# EasyEDA Pro project Cerberus_Sub_Controller_v01.eprj, board Cerberus_Sub_Controller_v01 (continued)
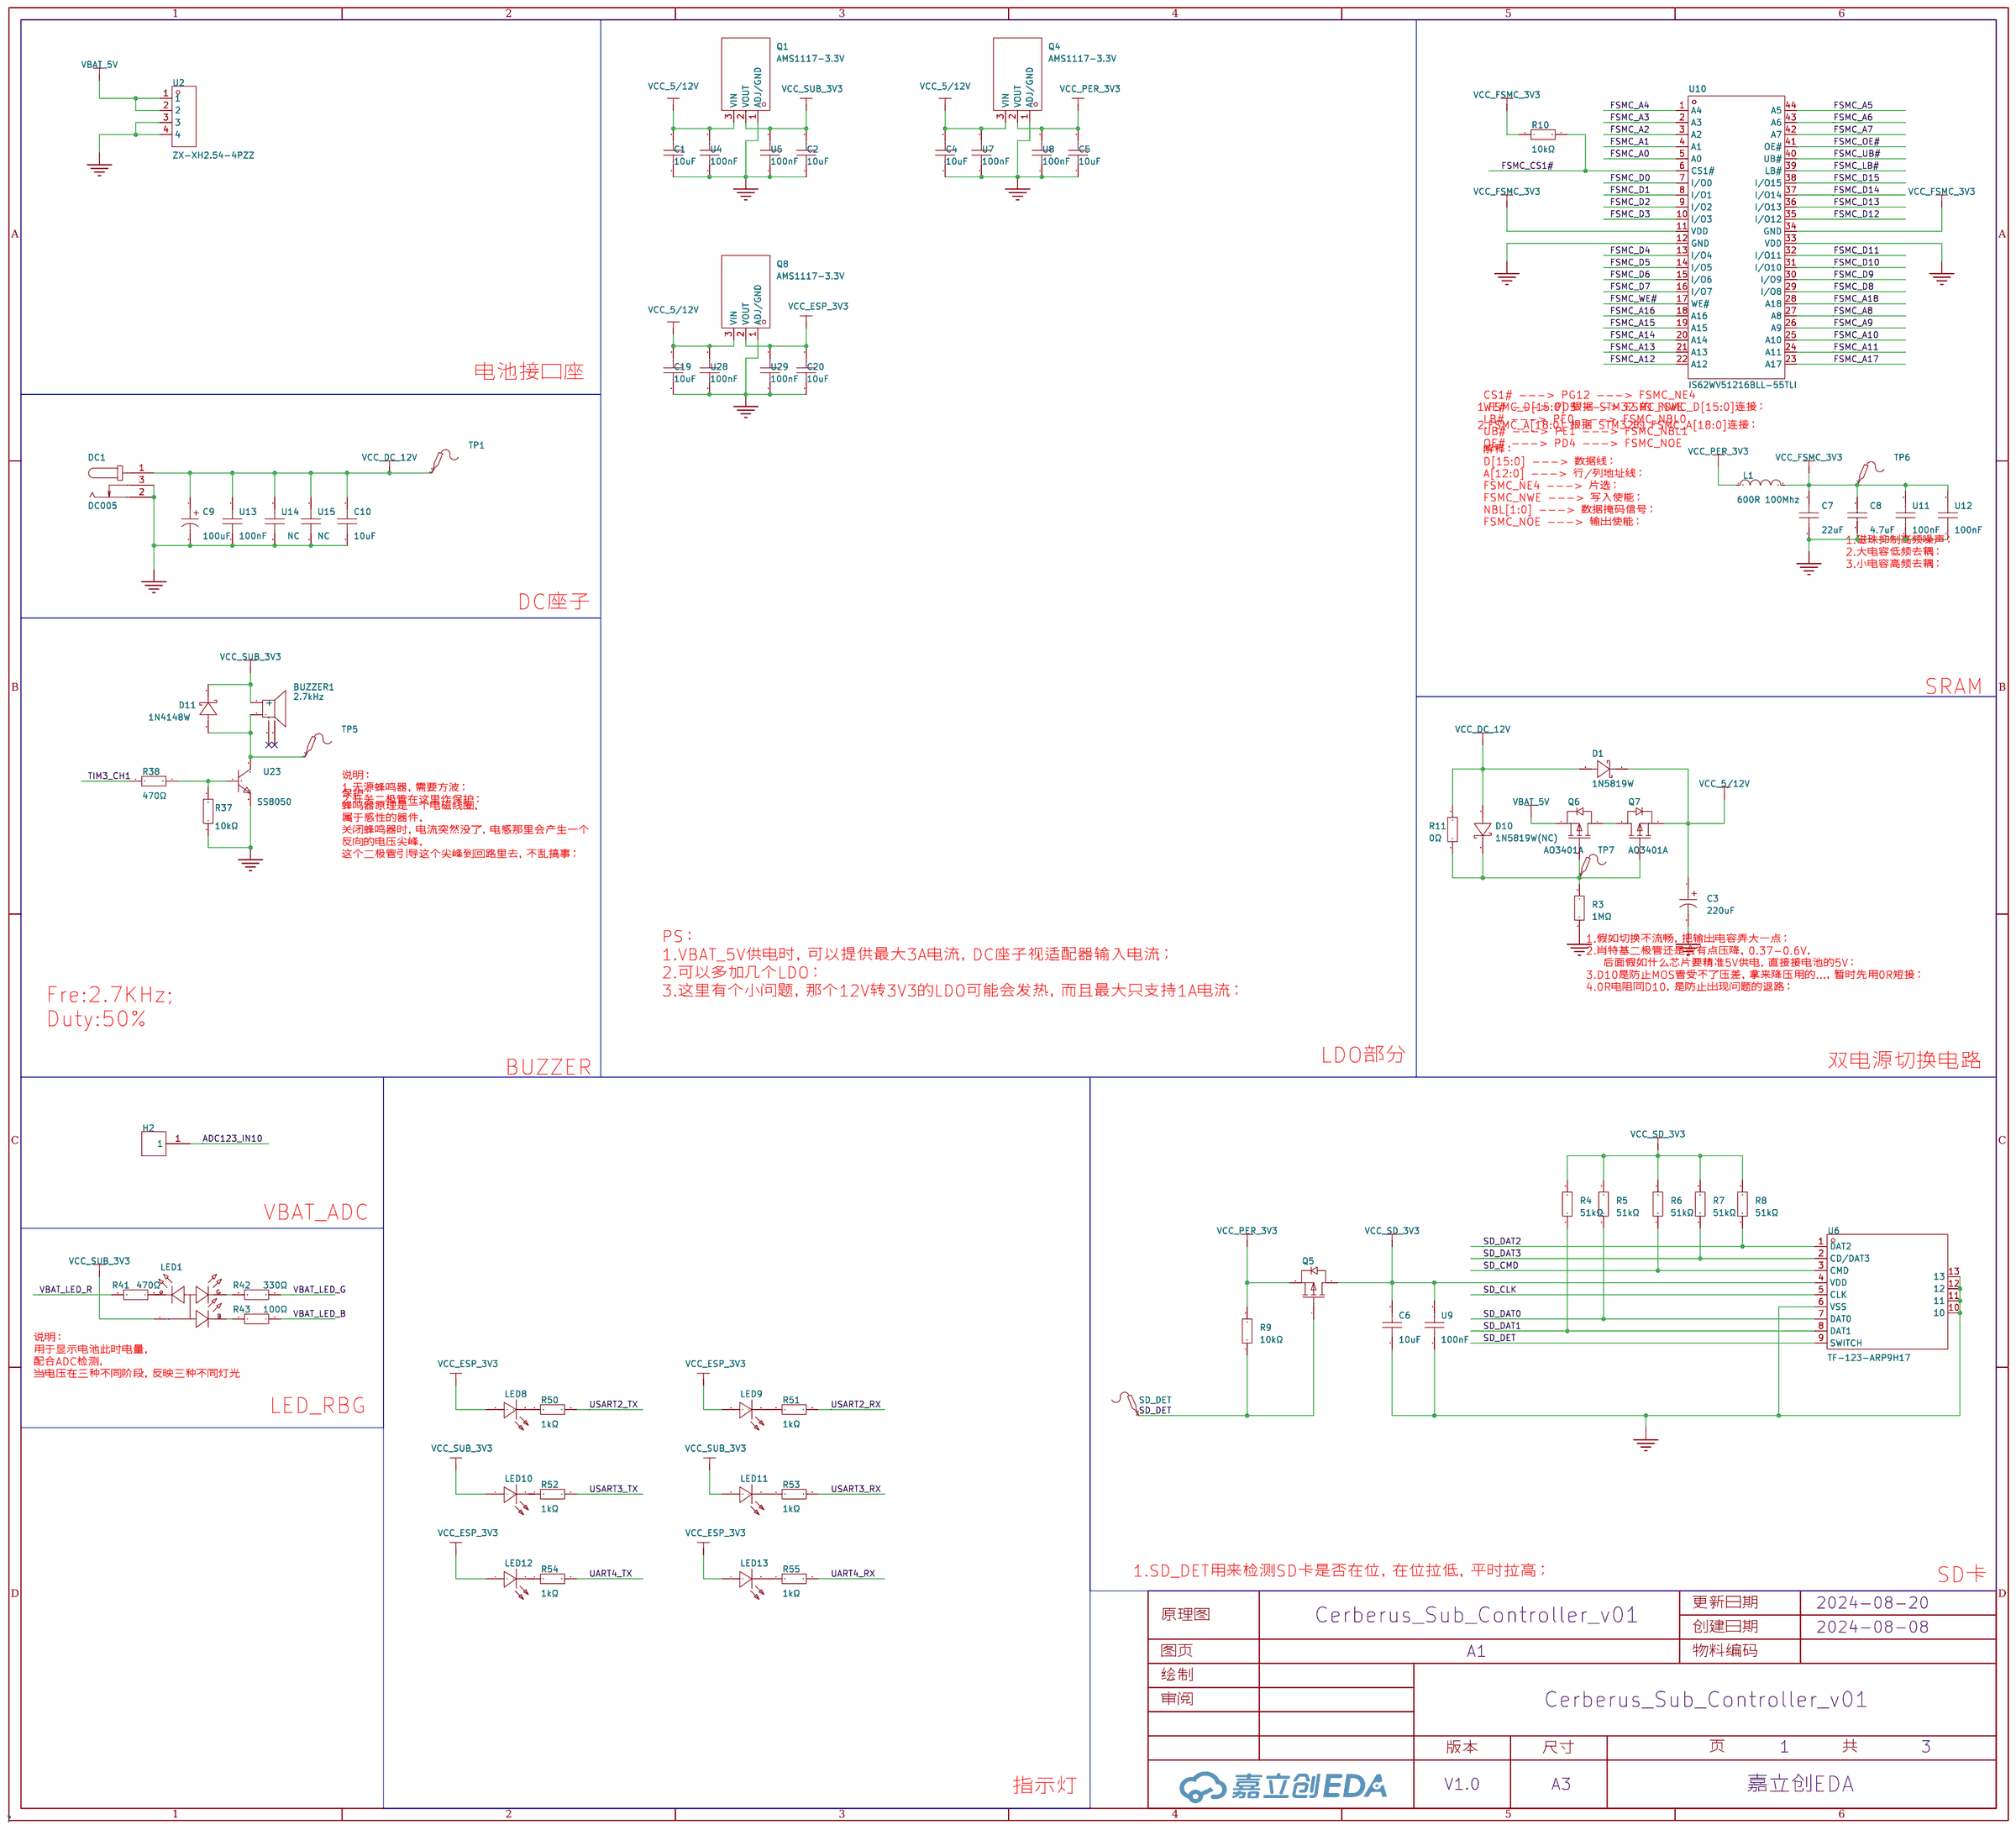
[diagram p0: A1]
## Routing (per net, layer and track width the routed paths; a pad name or vN(x,y) marks a point on that pad's centre or on a via; arc(x,y) is an arc through that point) (continued)
PC13: length 33.6
  Top Layer w0.203: U24.16 50.93,69.59 52.32,69.59 59.06,62.86 59.06,58.54 v1(60.71,56.89)
  SN_IMT w0.381: v1(60.58,50.92) 60.71,51.04 v1(60.71,56.89)
PD2: length 42.9
  Top Layer w0.203: U6.3 38.99,66.41 v1(38.1,65.52) ; v1(42.67,60.44) 42.67,54.98 48.26,49.39 v1(53.97,49.39)
  POWER w0.381: v1(53.97,49.39) 55.04,48.33 55.04,42.61 58.67,38.98 v1(59.69,38.98)
  Bottom Layer w0.203: 38.1,65.02 v1(38.1,65.52) ; 38.1,65.02 38.1,65.01 v1(42.67,60.44) ; 38.1,65.02 R6.1
PD3: length 58.6
  Top Layer w0.203: v1(62.36,65.39) 60.2,67.55 60.2,70.47 U24.20 ; CN1.39 66.34,38.94 v1(66.42,38.85)
  SN_NRM w0.381: v1(62.36,65.39) 64.64,63.11 70.61,63.11 74.42,59.3 74.42,41.77 71.25,38.6 66.68,38.6 v1(66.42,38.85)
PD6: length 79
  Top Layer w0.203: CN1.36 55.66,40.53 55.63,40.5
  SN_IMT w0.381: v1(33.4,73.27) 36.96,69.71 36.96,64.25 40.89,60.31 40.89,54.6 40.13,53.84 40.13,49.65 42.42,47.36 46.99,47.36 47.5,46.85 47.5,45.96 46.99,45.46 42.54,45.46 42.04,44.95 42.04,40.25 42.42,39.87 46.86,39.87 47.5,40.5 v1(55.5,40.5)
  SN_NRM w0.381: v1(33.4,73.27) 24.38,73.27 20.95,76.7
PD7: length 51.4
  Top Layer w0.203: v1(70.99,68.19) 70.23,68.19 67.18,71.24 61.98,71.24 U24.21 ; CN1.35 66.39,40.53 v1(66.42,40.5)
  SN_IMT w0.381: v1(70.99,68.19) 72.9,66.28 72.9,47.87 v1(71.12,46.09)
  Bottom Layer w0.203: v1(71.12,46.09) 66.42,41.39 v1(66.42,40.5)
PDR_ON: length 7.5
  Top Layer w0.203: CN1.18 59.81,47.74 R39.1 R40.2
PE2: length 45.5
  Top Layer w0.203: 59.06,76.7 63.5,72.25 68.07,72.25 73.66,66.67 v1(73.66,65.14) ; v1(72.01,56.12) v1(72.01,49.14)
  Bottom Layer w0.203: v1(64.39,47.74) 65.79,47.74 66.24,47.28 70.16,47.28 v1(72.01,49.14) ; v1(72.01,56.12) 73.66,57.78 v1(73.66,65.14)
PE3: length 47
  SN_IMT w0.381: 38.74,76.7 47.5,67.94 52.83,67.94 56.39,64.38 56.39,56.63 58.04,54.98 58.93,54.98 v1(59.82,55.87)
  SN_NRM w0.381: v1(59.06,48.63) 61.47,48.63 62.36,49.52 62.36,54.98 61.47,55.87 v1(59.82,55.87)
PE4: length 44.9
  Top Layer w0.203: v1(76.58,63.11) 76.58,65.01 68.33,73.27 65.02,73.27 U24.23 ; v1(70.99,54.22) v1(70.99,49.14)
  Bottom Layer w0.203: v1(64.39,48.5) 70.36,48.5 v1(70.99,49.14) ; v1(76.58,63.11) 76.58,59.81 v1(70.99,54.22)
PE5: length 41
  Top Layer w0.203: CN1.14 60.9,49.33 61.72,50.16 v1(61.72,51.17)
  SN_IMT w0.381: v1(58.55,55.87) 58.55,64.38 53.85,69.08 48.9,69.08 41.28,76.7
  Bottom Layer w0.203: v1(58.55,55.87) 59.56,54.85 60.96,54.85 61.72,54.09 v1(61.72,51.17)
PE6: length 40.5
  Top Layer w0.203: U24.24 66.8,74.03 68.58,74.03 77.09,65.52 v1(77.09,64)
  POWER w0.381: v1(67.06,51.04) 66.67,51.04 66.17,50.55 66.17,49.9 65.53,49.27 v1(64.9,49.27)
  Bottom Layer w0.203: v1(67.06,51.04) 68.71,51.04 77.09,59.43 v1(77.09,64)
PF6: length 141.3
  Top Layer w0.203: v1(16.26,21.96) 12.45,18.15 4.06,18.15 3.17,17.26 3.17,3.29 5.08,1.39 59.94,1.39 U25.8 ; 37.38,54.14 37.38,54.56 36.45,55.49 33.66,55.49 32.89,56.25 v1(32.13,56.25)
  SN_IMT w0.381: v1(32.13,56.25) 26.29,56.25 24,53.97 20.95,53.97 18.8,51.81 18.8,33.77 v1(16.64,31.61)
  Bottom Layer w0.203: v1(16.26,21.96) 16.26,31.23 v1(16.64,31.61)
PF7: length 61.1
  SN_IMT w0.381: 38.74,3.04 33.4,8.37 v1(33.4,25.01)
  POWER w0.381: v1(30.23,43.3) 31.24,44.31 34.16,44.31 35.05,45.2 35.05,53.33 34.29,54.09 v1(33.15,54.09)
  SN_NRM w0.381: v1(30.23,43.3) v1(30.23,37.96)
  Bottom Layer w0.203: v1(30.23,37.96) 32.51,35.68 33.4,35.68 34.42,34.66 34.42,32.25 33.4,31.23 v1(33.4,25.01)
PF8: length 145.2
  Top Layer w0.203: v1(17.65,21.96) 12.95,17.26 v1(4.57,17.26)
  SN_IMT w0.381: v1(37.72,53.33) 38.61,53.33 38.99,53.71 38.99,55.74 36.32,58.41 26.92,58.41 v1(23.62,55.11)
  POWER w0.381: v1(17.65,31.61) 17.65,52.19 20.57,55.11 v1(23.62,55.11)
  Bottom Layer w0.203: v1(4.57,17.26) 3.68,16.37 3.68,2.91 5.33,1.26 57.28,1.26 59.06,3.04 ; v1(17.65,21.96) v1(17.65,31.61)
PF9: length 57
  POWER w0.381: v1(33.02,53.33) 34.04,53.33 34.42,52.95 34.42,49.9 33.78,49.27 32.51,49.27 29.56,46.31 29.56,29.11 v1(32.51,26.15)
  SN_NRM w0.381: U25.18 32.51,6.72 v1(32.51,26.15)
PF11: length 44.8
  Top Layer w0.203: 15.88,3.04 18.92,6.09 29.72,6.09 31.24,7.61 v1(31.24,24.63)
  Bottom Layer w0.203: v1(31.24,24.63) 30.35,25.52 30.35,31.87 30.99,32.5 v1(33.02,32.5)
PG6: length 116.9
  Top Layer w0.203: v1(25.27,13.96) 27.18,12.06 v1(30.73,12.06)
  SN_IMT w0.381: v1(20.19,24.37) 13.08,31.49 13.08,61.97 8,67.05 8,74.41 5.72,76.7 ; v1(25.27,13.96) 23.63,15.6 21.47,15.6 v1(21.08,15.99)
  SN_NRM w0.381: v1(37.47,16.12) 42.93,21.58 42.93,23.1 45.85,26.03 55.25,26.03 57.91,28.69 57.91,30.6 58.29,30.98 v1(59.44,30.98)
  Bottom Layer w0.203: v1(21.08,15.99) 20.19,16.88 v1(20.19,24.37) ; v1(30.73,12.06) 34.8,16.12 v1(37.47,16.12)
PG7: length 65
  Top Layer w0.203: v1(59.69,61.2) 59.69,63.36 U24.17 ; v1(65.79,30.85) 65.7,30.94 CN1.59
  SN_IMT w0.381: v1(65.79,30.85) 66.93,30.85 70.99,34.92 v1(70.99,42.79)
  SN_NRM w0.381: v1(70.99,42.79) 70.36,43.42 70.36,57.39 68.07,59.68 60.32,59.68 59.69,60.31 v1(59.69,61.2)
PG8: length 116.8
  Top Layer w0.203: v1(14.99,33.64) 14.99,30.85 v1(21.34,24.5) ; v1(30.73,13.32) 27.81,13.32 v1(25.15,15.99) ; v1(41.4,25.26) 40,25.26 37.72,22.98 37.72,17.9 v1(36.7,16.88)
  SN_IMT w0.381: v1(21.84,16.37) 24.77,16.37 v1(25.15,15.99) ; U24.2 10.54,74.41 10.54,68.44 14.35,64.63 14.35,55.23 13.97,54.85 13.97,34.66 v1(14.99,33.64)
  SN_NRM w0.381: v1(59.44,31.74) 57.78,31.74 57.02,30.98 57.02,29.2 54.48,26.66 44.45,26.66 43.05,25.26 v1(41.4,25.26)
  Bottom Layer w0.203: v1(30.73,13.32) 34.29,16.88 v1(36.7,16.88) ; v1(21.34,24.5) 21.34,16.88 v1(21.84,16.37)
PG9: length 64.8
  Top Layer w0.203: v1(54.48,53.97) 54.48,52.82 55.5,51.81 55.5,50.79 57.53,48.76 v1(57.53,48.63) ; v1(58.17,42.15) 58.99,41.33 CN1.34
  POWER w0.381: v1(56.9,46.09) 56.51,45.7 56.51,43.31 57.66,42.15 v1(58.17,42.15)
  SN_NRM w0.381: 23.5,76.7 26.16,74.03 48.01,74.03 54.48,67.55 v1(54.48,53.97)
  Bottom Layer w0.203: v1(57.53,48.63) 57.53,46.73 v1(56.9,46.09)
PG10: length 9.3
  Top Layer w0.203: R42.2 67.63,41.33 CN1.33
PG11: length 63.9
  SN_NRM w0.381: v1(61.59,47.87) 62.99,49.27 62.99,57.27 62.61,57.65 60.96,57.65 58.93,59.68 58.93,64.63 48.64,74.92 27.81,74.92 26.03,76.7
  Bottom Layer w0.203: v1(61.59,47.87) 61.59,43.3 v1(60.58,42.28)
PG13: length 58.4
  Top Layer w0.203: v1(61.47,42.41) 60.94,42.94 CN1.30
  SN_IMT w0.381: U24.10 34.16,71.11 34.16,61.84 v1(38.86,57.14)
  SN_NRM w0.381: v1(38.86,57.14) 40,57.14 43.94,53.2 56.01,53.2 v1(57.15,52.06) 58.17,51.04 58.17,48.25 59.44,46.98 60.96,46.98 61.47,46.47 v1(61.47,42.41)
PG14: length 9.1
  Top Layer w0.203: R43.2 67.93,42.94 CN1.29
PG15: length 50.4
  Top Layer w0.203: v1(57.4,43.68) 59.76,43.68 CN1.28
  SN_IMT w0.381: v1(51.44,48) 46.99,48 41.4,53.58 41.4,60.82 37.47,64.76 37.47,70.35 31.12,76.7
  SN_NRM w0.381: v1(51.44,48) 51.44,47.11 52.45,46.09 54.99,46.09 v1(57.4,43.68)
SD_DET: length 14.9
  Top Layer w0.203: U6.9 42.73,64.96 43.43,64.25 48.94,64.25 Q5.1 50.86,64.7 R9.1 51.24,64.71 SD_DET.1
SWCLK: length 65.1
  Top Layer w0.203: U24.19 51.82,76.7 58.55,69.97 58.55,67.68 v1(60.83,65.39) ; CN1.47 66.35,35.73 v1(66.42,35.8) ; v1(73.66,48.63) v1(75.31,46.98)
  SN_NRM w0.381: v1(66.42,35.8) 74.04,35.8 75.31,37.07 v1(75.31,46.98) ; v1(73.66,48.63) 73.66,58.92 70.36,62.22 64.01,62.22 v1(60.83,65.39)
SWDIO: length 82.3
  Top Layer w0.203: v1(51.56,48.89) 50.29,47.61 50.29,45.96 v1(51.82,44.44)
  SN_IMT w0.254: v1(51.44,38.09) 52.96,36.57 54.86,36.57 55.63,35.8 v1(59.18,35.8)
  POWER w0.254: v1(51.82,44.44) 51.82,40.5 51.44,40.12 v1(51.44,38.09)
  SN_NRM w0.381: v1(40.26,71.62) 20.95,71.62 15.88,76.7
  Bottom Layer w0.203: v1(40.26,71.62) 50.04,71.62 53.85,67.81 53.85,52.95 52.07,51.17 52.07,49.39 v1(51.56,48.89)
VREF+: length 57.2
  Top Layer w0.203: v1(29.21,8.25) 24.51,12.94 v1(24.51,21.83) ; CN2.51 32.83,50.79 30.35,50.79 29.34,49.77 27.56,49.77 v1(27.05,49.27)
  Bottom Layer w0.203: v1(29.21,8.25) 31.12,6.34 31.12,3.04 ; v1(27.05,49.27) 23.88,46.09 23.88,22.47 v1(24.51,21.83)
$1N508:
  vias: v1(89.03,46.73) v1(89.03,46.09) v1(89.03,44.31) v1(89.03,42.53) v1(89.03,41.9) v1(90.04,44.31) v1(91.06,44.31)
$1N7566:
  vias: v1(83.76,36.94) v1(84.58,46.8) v1(84.65,45.62) v1(86.73,45.52) v1(86.73,41.2) v1(86.85,37.81)
$1N11787: length 12
  Top Layer w0.203: U23.3 76.6,22.94 BUZ_SN.1
  Top Layer w0.381: 76.58,24.14 77.66,23.06 BUZZER1.2 80.79,22.99 ; 76.58,24.14 D11.1 ; 76.58,24.14 76.58,22.99 U23.3
$1N11843: length 3.5
  Top Layer w0.203: U23.1 74.5,23.87 R38.2 R37.2
$1N12167: length 2.7
  Top Layer w0.203: R41.2 73.34,41.08 73.34,43.66
$1N12224: length 7.3
  Bottom Layer w0.203: v1(73.28,37.07) 72.64,37.71 72.64,42.78 v1(71.73,43.69)
$1N12304: length 6
  Bottom Layer w0.203: v1(71.7,44.46) 73.03,43.13 73.03,39.39 v1(73.31,39.11)
$1N13565: length 2.4
  Top Layer w0.203: TX2.2 20.41,17.9 R50.1
$1N13573: length 2.4
  Top Layer w0.203: RX2.2 20.45,14.38 R51.1
$1N13763: length 2.2
  Top Layer w0.203: TX3.2 61.73,7.61 R52.1
$1N13771: length 2.2
  Top Layer w0.203: R53.1 61.81,10.07 RX3.2
$1N13961: length 2.4
  Top Layer w0.203: R54.1 20.54,7.36 TX4.2
$1N13969: length 2.4
  Top Layer w0.203: R55.1 20.5,10.87 RX4.2
$2N431: length 2.8
  Top Layer w0.203: USB1.4 v1(90.93,68.08)
$2N434: length 2.8
  Top Layer w0.203: USB1.10 90.83,71.08 v1(90.93,70.98)
$2N1990: length 5.2
  Top Layer w0.203: R12.2 61.59,15.18 61.59,17.26 62.11,17.77 U16.9
$2N2067: length 2.2
  Top Layer w0.203: U16.10 62.61,17.17 C11.2
$2N2156: length 21.1
  Top Layer w0.203: v1(63.63,18.28) 63.61,18.3 U16.12
  SN_NRM w0.381: v1(63.63,18.28) 59.44,14.09 55.25,14.09 53.59,15.74 53.59,20.94 52.07,22.47 v1(51.44,22.47)
$2N2359: length 3.1
  Top Layer w0.203: C14.1 64.66,24.75 63.63,24.75 63.11,24.23 U16.20
$2N2438: length 2.9
  Top Layer w0.203: U16.24 v1(61.11,25.14)
  Bottom Layer w0.203: v1(61.11,25.14) 61.11,25.7 R14.1
$2N2441: length 1.5
  Top Layer w0.203: v1(61.89,24.37) 61.61,24.09 U16.23
$2N3213: length 1.3
  Top Layer w0.203: 51.09,18.02 50.84,17.77 U17.5
$2N5650: length 17.9
  Top Layer w0.203: R33.2 64.51,62.47 79.76,62.47 80.14,62.86 U1.6
$2N5692: length 22.1
  Top Layer w0.203: R34.2 62.19,62 79.95,62 81.41,63.46 81.41,64.49
$2N6121: length 17.6
  Top Layer w0.203: OPENMV4.3 9.29,68.3 19.18,58.41 21.73,58.41 R36.2
$2N6127: length 15.3
  Top Layer w0.203: R35.2 21.73,60.06 18.54,60.06 11.79,66.81 OPENMV4.2
$2N7761: length 3.8
  Bottom Layer w0.203: U30.3 5.49,54.7 R57.2
$2N9014: length 4.9
  Top Layer w0.203: ESP_IO0.4 11.3,26.15 13.59,26.15 13.88,26.44 v1(13.88,27.17)
$2N9237: length 9.3
  Top Layer w0.203: ESP_RST.4 12.32,58.59 12.32,64.51
  Bottom Layer w0.203: v1(12.32,64.53) R69.2
$2N9578: length 7.2
  Bottom Layer w0.203: R60.2 1.65,23.74 H8.1 H8.3
$2N9587: length 9.2
  Bottom Layer w0.203: H9.3 H9.1 8.77,22.85 R61.2

## Copper pours and planes (outline as drawn; the poured copper is in the pictures)
GND on Top Layer: -0.25,80.76 98.04,80.76 98.04,-0.9 -0.25,-0.9
GND on Bottom Layer: -1.4,82.86 98.68,82.86 98.68,-1.53 -1.4,-1.53
GND on SN_IMT: -1.91,82.03 97.79,82.03 97.79,-1.53 -1.91,-1.53
GND on GND: 0.26,79.74 94.74,79.74 94.74,0.26 0.26,0.26
GND on POWER: -1.4,83.05 98.68,83.05 98.68,-1.53 -1.4,-1.53
GND on SN_NRM: -1.65,83.05 98.3,83.05 98.3,-1.15 -1.65,-1.15
VBAT_5V on Bottom Layer: 82.55,46.09 84.33,44.31 86.49,44.31 87.25,43.55 87.25,42.66 86.49,41.9 84.33,41.9 82.8,40.38 81.03,40.38 80.01,41.39 80.01,45.09 81.02,46.09
VCC_5/12V on Bottom Layer: 76.71,56.63 77.6,57.52 84.07,57.52 84.71,56.89 84.71,54.52 84.07,53.89 77.68,53.89 76.71,54.85
VCC_5/12V on Bottom Layer: 86.11,46.98 87.38,46.98 88.52,48.12 88.52,50.03 88.01,50.54 85.98,50.54 85.47,50.03 85.47,47.61
VCC_5/12V on Bottom Layer: 81.66,37.33 82.3,37.96 82.3,39.16 81.72,39.74 78.87,39.74 78.49,39.36 78.49,37.71 78.87,37.33
VCC_5/12V on POWER: 86.11,46.85 87.47,46.85 88.58,47.97 88.58,53.03 84.07,57.54 80.01,57.54 79.25,56.78 79.25,55.49 79.63,55.11 81.91,55.11 85.47,51.55 85.47,47.61 85.98,47.11 85.98,46.98
VCC_5/12V on POWER: 76.58,54.98 76.58,56.89 71.63,61.84 52,61.84 51.32,61.16 51.32,60.58 51.05,60.31 50.04,60.31 49.78,60.57 49.78,61.2 49.15,61.84 27.9,61.84 26.93,60.88 26.93,60.32 26.8,60.19 25.4,60.19 25.27,60.31 25.27,60.95 23.11,63.11 23.11,63.87 23.5,64.25 74.47,64.25 75.06,63.65 75.06,62.27 80.48,56.85 80.48,55.96 79.5,54.98
VCC_5/12V on POWER: 78.74,37.33 81.66,37.33 81.66,40.5 80.01,42.15 80.01,53.97 81.15,55.11 83.51,55.11 83.51,56.63 81.31,56.63 80.48,57.45 80.48,57.61 77.55,57.61 76.58,56.63 76.58,39.49
VCC_DC_12V on Bottom Layer: 79.79,35.28 80.58,36.06 86.5,36.06 87.72,34.84 87.72,33.99 86.61,32.88 80.65,32.88 79.88,33.52 79.79,33.73
VCC_DC_12V on POWER: 82.59,8.92 83.44,9.77 83.44,22.29 85.95,24.81 85.95,32.48 87.63,34.15 87.63,34.92 86.79,35.76 83.23,35.76 83.19,35.8 80.81,35.8 79.63,34.63 79.63,33.77 80.52,32.88 82.17,32.88 82.55,32.5 82.55,27.04 79.25,23.74 79.25,10.28 80.61,8.92
VCC_ESP_3V3 on POWER: 18.8,65.52 22.61,65.52 23.11,65.01 23.11,64.12 20.91,62.43 18.8,61.2 18.16,64 18.16,64.89
VCC_ESP_3V3 on POWER: 19.05,61.46 20.57,61.46 20.95,61.84 21.21,61.84 21.21,62.98 21.34,63.11 20.7,63.11
VCC_ESP_3V3 on POWER: 14.73,51.81 15.24,52.31 16.13,52.31 16.26,52.19 16.26,49.77 16.13,49.65 14.73,49.65
VCC_PER_3V3 on Bottom Layer: 43.96,64.76 43.96,59.55 44.47,59.05 46.86,59.05 47.37,59.55 47.37,64.72 47.41,64.76
VCC_PER_3V3 on POWER: 47.11,58.91 47.08,58.94 44.24,58.94 43.69,59.5 43.69,60.82 44.2,61.33 48.26,61.33 50.16,59.43 49.65,58.91
VCC_PER_3V3 on POWER: 46.48,59.43 46.73,29.83 40.26,23.36 40.26,16.75 40.89,16.12 43.6,16.12 44.32,16.85 44.32,22.15 50.93,28.76 50.93,58.66 49.91,59.68 47.88,59.68
VCC_SD_3V3 on Bottom Layer: 34.29,67.94 34.54,68.19 36.19,68.19 36.39,67.99 36.39,66.49 36.19,66.29 34.54,66.29 34.29,66.54
VCC_SD_3V3 on POWER: 36.45,68.95 36.83,68.57 36.83,67.64 36.61,67.43 34.42,67.43 34.29,67.55 34.29,68.57 34.67,68.95
VCC_SUB_3V3 on Bottom Layer: 67.38,64.95 67.38,67.37 67.82,67.81 70.49,67.81 70.87,67.43 70.87,64.76 70.49,64.38 67.93,64.38 67.36,64.95
VCC_SUB_3V3 on Bottom Layer: 67.44,64.87 67.44,60.44 67.69,60.19 70.49,60.19 70.74,60.44 70.74,65.56 68.12,65.56
VCC_SUB_3V3 on POWER: 67.44,60.84 67.45,60.84 67.69,61.08 70.49,61.08 70.74,60.82 70.74,59.81 70.49,59.55 67.69,59.55 67.44,59.81
VCC_SUB_3V3 on POWER: 79.76,31.49 81.15,31.49 81.66,30.98 81.66,29.45 81.15,28.95 79.73,28.95 78.74,29.94 78.74,30.47
VCC_SUB_3V3 on POWER: 67.56,28.18 67.56,16.88 66.8,16.12 66.8,14.72 67.44,14.09 69.6,14.09 70.36,14.85 70.36,28.69 68.07,28.69
VCC_SUB_3V3 on POWER: 67.56,56.5 67.56,28.18 68.07,27.68 69.85,27.68 70.49,28.31 70.49,55.76 69.72,56.5 69.72,57.52 68.58,57.52
VCC_SUB_3V3 on POWER: 67.44,60.44 67.44,56.38 65.91,54.85 59.18,54.85 58.8,54.47 58.8,54.09 59.06,53.84 62.99,53.84 63.25,53.58 63.25,53.2 63.37,53.08 68.71,53.08 70.61,54.98 70.61,60.31 70.48,60.44
VCC_SUB_3V3 on POWER: 67.44,67.3 67.82,67.68 70.49,67.68 70.87,67.3 70.87,65.9 70.61,65.65 67.82,65.65 67.44,66.03
VCC_SUB_3V3 on POWER: 67.82,67.68 67.82,77.32 68.46,77.97 80.08,77.97 80.65,77.41 80.65,76.06 80.01,75.43 70.99,75.43 70.36,74.79 70.36,67.68 70.49,67.55 67.94,67.55
$1N508 on Bottom Layer: 88.26,46.73 89.03,47.49 91.1,47.49 91.69,46.9 91.69,41.77 91.06,41.14 88.77,41.14 88.26,41.65
$1N508 on POWER: 88.9,41.01 88.26,41.65 88.26,46.79 88.96,47.49 91.19,47.49 91.82,46.85 91.82,41.65 91.19,41.01
$1N7566 on POWER: 86.59,36.19 87.72,37.31 87.72,45.62 87.18,46.16 86.16,46.16 85.08,47.23 84.2,47.23 83.95,46.98 83.95,45.7 84.65,45 85.68,45 85.98,44.69 85.98,38.6 85.6,38.22 83.19,38.22 82.68,37.71 82.68,36.73 83.23,36.19

Small or netless copper shapes (teardrops, artwork), in the pictures only: 335 on Top Layer, 272 on Bottom Layer, 15 on SN_IMT, 100 on GND, 16 on POWER, 9 on SN_NRM

## Text on the board
Bottom Silkscreen Layer: G6 | G8 | C7 | A11 | GND | F11 | SWDIO | B14 | A15 | D6 | B1 | G9 | C5 | G11 | A7 | G13 | A5 | VERF+ | G15 | B4 | C2 | F9 | B6 | F7 | E3 | E5 | B15 | C13 | B13 | B0 | G7 | C4 | A8 | A4 | SWCLK | C3 | D3 | C1 | D7 | F8 | E2 | E4 | F6 | E6 | VBAT | 3V3
Top Silkscreen Layer: G|R2|T2 | E_TX | E_RX | RX2 | TX2 | ESP_IO16 | ESP_ADC | ESP_IO2 | ESP_IO4 | ESP_IO5 | VBAT_5V | GND | RX4 | TX4 | 5/12V | I2C1_SCL | I2C1_SDA | TX3 | ProJect : Cerberus_Sub_V01 / Fution : Cerberus dog / By Connor.Chen / 2024/08/17 | TX1 | RX3 | RX1
